# EasyEDA Pro project URADORRY-SUN1.2.eprj, schematic Main(1.2) (continued)
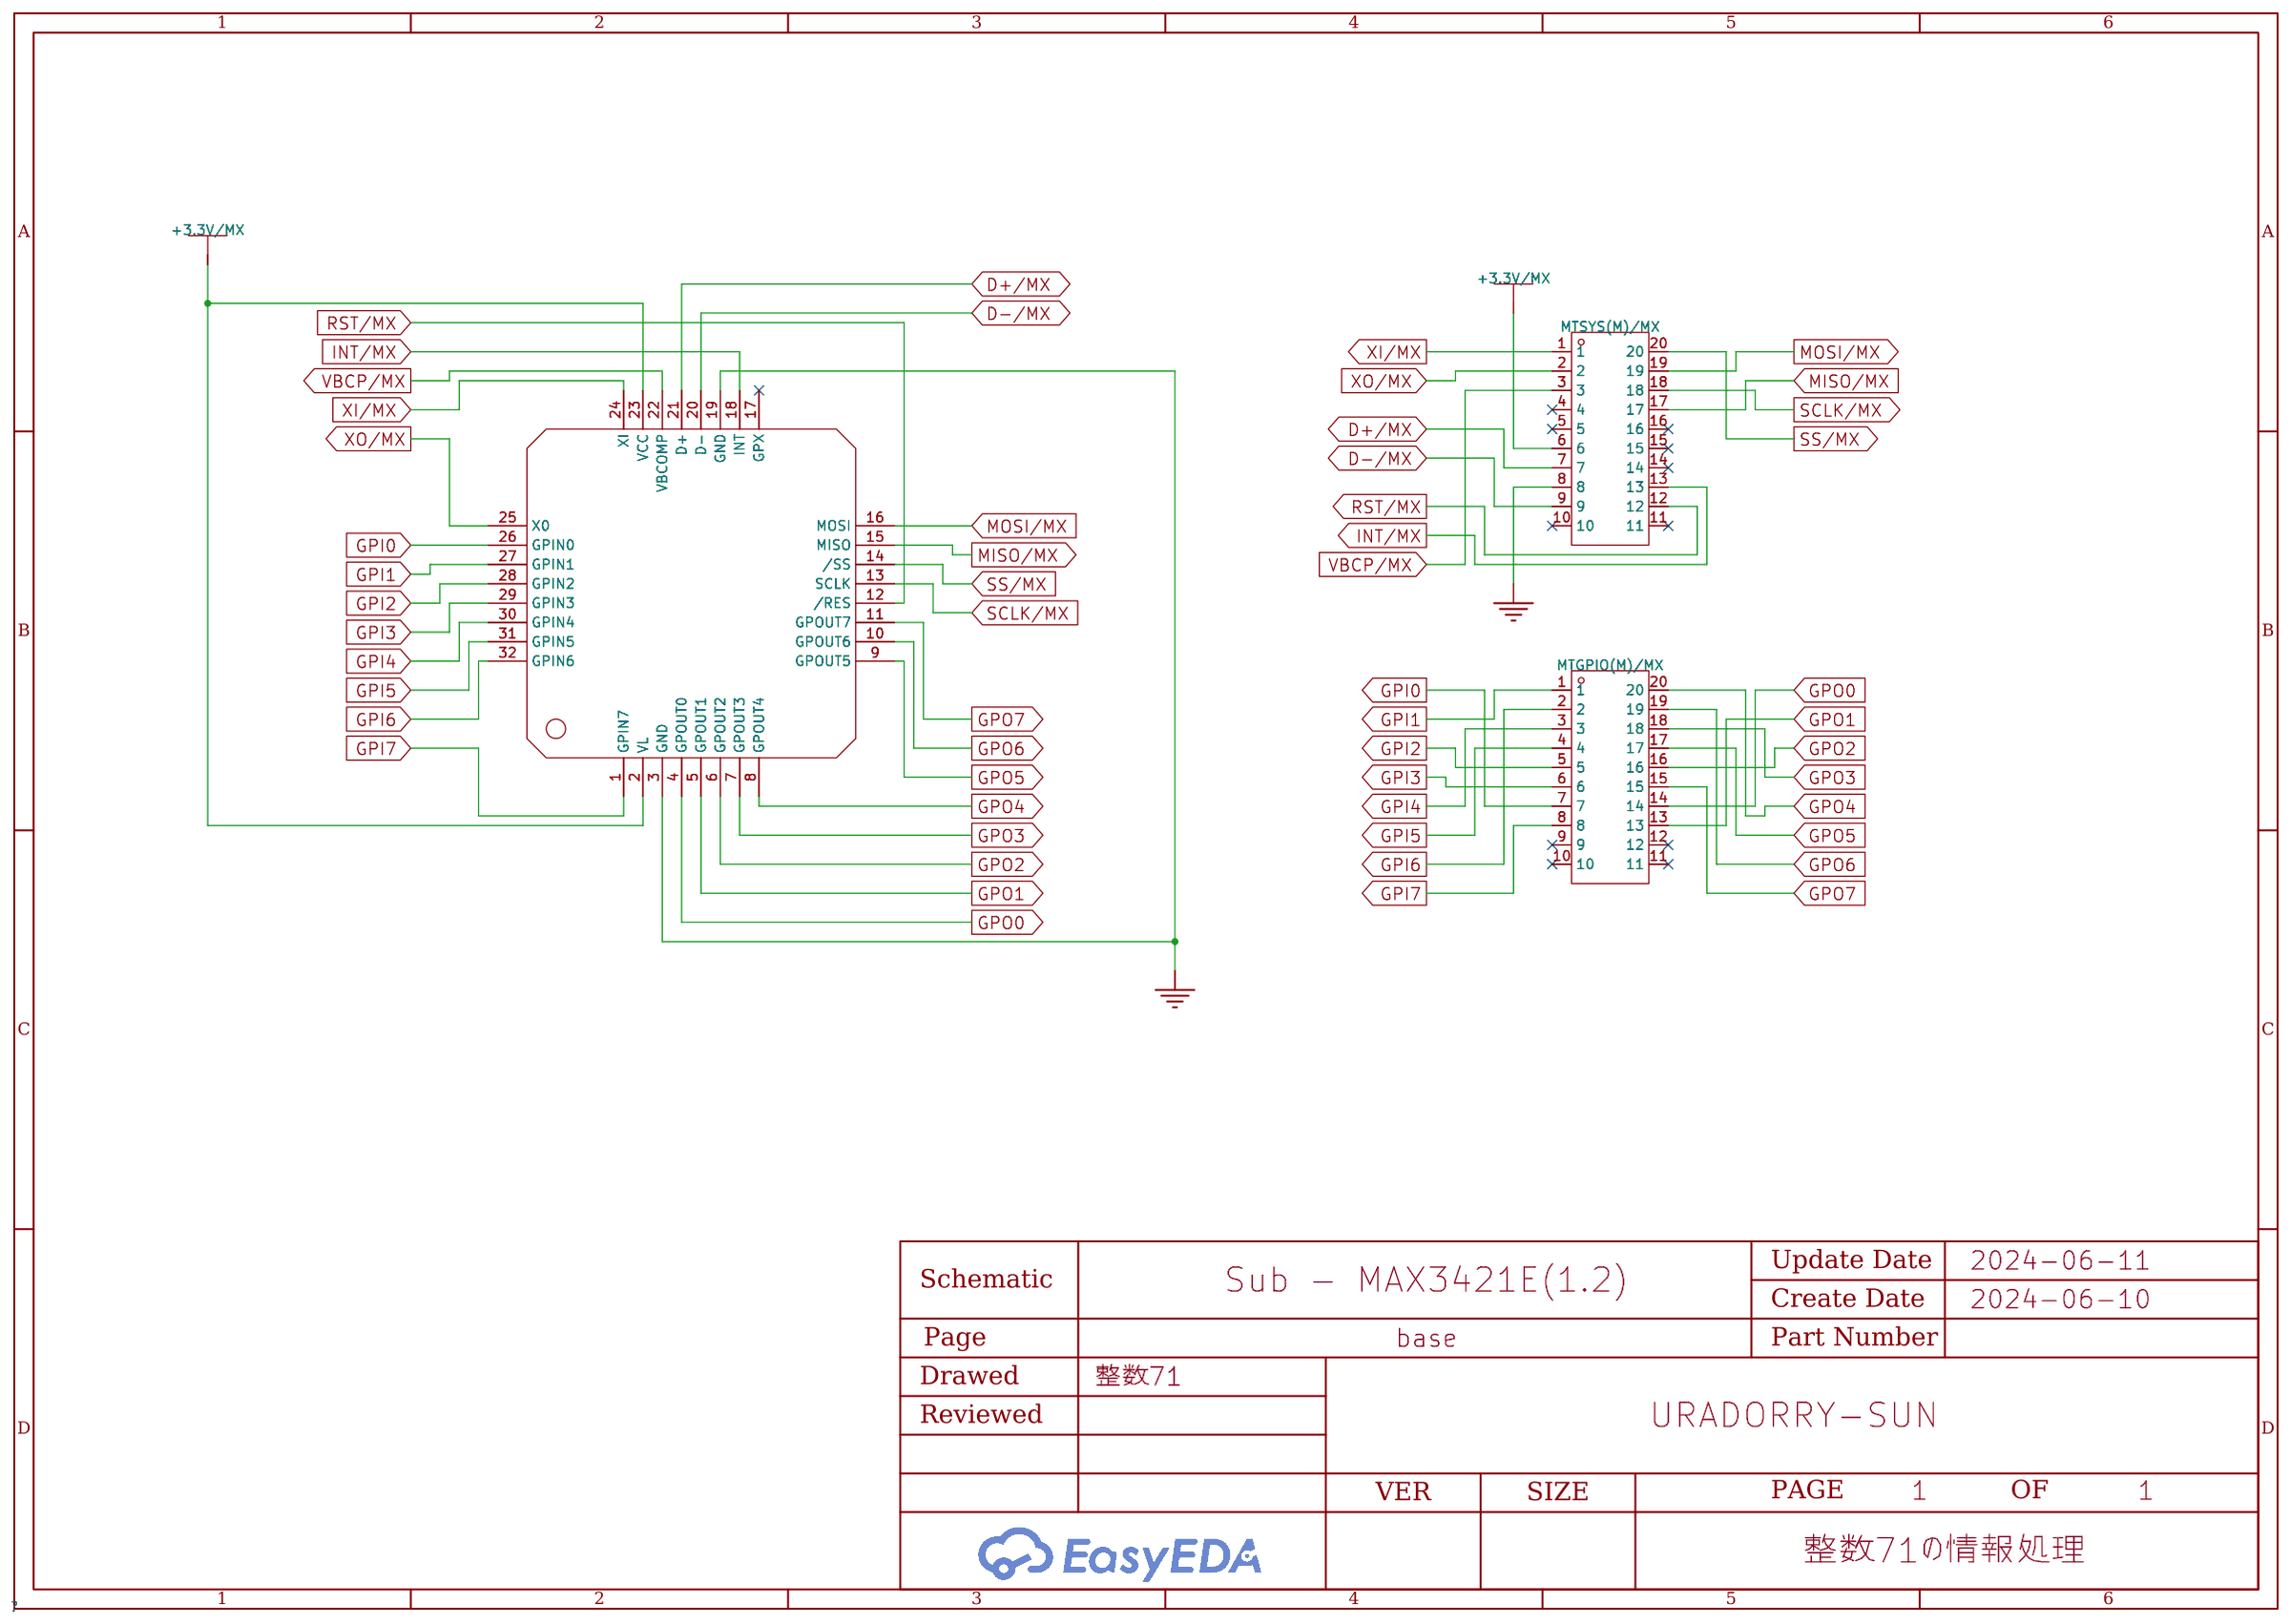
[diagram p0: schematic sheet]
## Library data of the parts (continued)
PINICSP = PinHeader-ICSP(6M) - Plugin2.54mm: Connector Type:简牛座 Pitch:2.54mm Structure:2x3P Current Rating (Max):3A Voltage Rating (Max):250V Holder Type:Straight Row Spacing:2.54mm Number of Rows:2 Pin Number in each Row:3 Operating Temperature Range:-40℃~+105℃ Operating Temperature Range:-40℃~+105; LCSC Part Name: 2.54mm 2x3P 排数:2 每排P数:3; Supplier Part: C2833845; Manufacturer: TXGA(特思嘉); Supplier Footprint: 插件,P=2.54mm; JLCPCB Part Class: Extended Part; Datasheet: https://atta.szlcsc.com/upload/public/pdf/source/20210517/C2833830_56D155BAD5515B3E78E7A5BA70C5789E.pdf; Supplier: LCSC; Connector Type: 简牛座; Pitch: 2.54mm; Structure: 2x3P; Current Rating (Max): 3A; Voltage Rating (Max): 250V; Holder Type: Straight; Row Spacing: 2.54mm; Number of Rows: 2; Pin Number in each Row: 3; Operating Temperature Range: -40℃~+105℃
RC/LM = 47kΩ(±1%) - Plugin3.5mm: Type:Metal Film Resistors Resistance: Tolerance:±1% Tolerance:±1% Overload Voltage (Max):150V Power(Watts):125mW Temperature Coefficient:±50ppm/℃ Temperature Coefficient:±50ppm/℃ Operating Temperature Range:-55℃~+125℃ Operating Temperature Range:-55℃~+125; LCSC Part Name: 47kΩ ±1% 125mW 金属膜电阻; Supplier Part: C433476; Manufacturer: Tyohm(幸亚电阻); Manufacturer Part: RN 1/8W 47K F T/B A1; Supplier Footprint: 插件,D1.7xL3.5mm; JLCPCB Part Class: Extended Part; Datasheet: https://atta.szlcsc.com/upload/public/pdf/source/20191008/C433681_B72693A7FD256E0D1DC5EFE3F095EED3.pdf; Supplier: LCSC; Type: Metal Film Resistors; Tolerance: ±1%; Overload Voltage (Max): 150V; Power(Watts): 125mW; Temperature Coefficient: ±50ppm/℃; Operating Temperature Range: -55℃~+125℃
RF1/LM = 100kΩ(±25%) - Plugin: Resistance: Tolerance:±25% Tolerance:±25% Power(Watts):; LCSC Part Name: 100kΩ ±25%; Supplier Part: C5205024; Manufacturer: BOCHEN(博晨); Manufacturer Part: RM065-104(100K); Supplier Footprint: 插件; JLCPCB Part Class: Extended Part; Datasheet: https://atta.szlcsc.com/upload/public/pdf/source/20221019/6263C46FBC7F1B66CBAADA74DC5EFAA2.pdf; Supplier: LCSC; Tolerance: ±25%
RF2/LM = 20kΩ(±1%) - Plugin3.2mm: Type:Metal Film Resistors Resistance: Tolerance:±1% Tolerance:±1% Overload Voltage (Max):150V Power(Watts):125mW Temperature Coefficient:±100ppm/℃ Temperature Coefficient:±100ppm/℃ Operating Temperature Range:-55℃~+155℃ Operating Temperature Range:-55℃~+1; LCSC Part Name: 20kΩ ±1% 125mW 金属膜电阻; Supplier Part: C119208; Manufacturer: CCO(千志电子); Manufacturer Part: MF1/8W-20KΩ±1% T; Supplier Footprint: 插件,D1.8xL3.2mm; JLCPCB Part Class: Extended Part; Datasheet: https://atta.szlcsc.com/upload/public/pdf/source/20190910/C427326_62A6D058BC0FF74963A2F22379CA06CE.pdf; Supplier: LCSC; Type: Metal Film Resistors; Tolerance: ±1%; Overload Voltage (Max): 150V; Power(Watts): 125mW; Temperature Coefficient: ±100ppm/℃; Operating Temperature Range: -55℃~+155℃
RLED+3.3V RLEDGPO0 RLEDGPO3 RLEDGPO5 RLEDRX/AT = 300Ω(±1%) - Plugin3.5mm: Type:Metal Film Resistors Resistance: Tolerance:±1% Tolerance:±1% Overload Voltage (Max):150V Power(Watts):125mW Temperature Coefficient:±50ppm/℃ Temperature Coefficient:±50ppm/℃ Operating Temperature Range:-55℃~+125℃ Operating Temperature Range:-55℃~+125; LCSC Part Name: 300Ω ±1% 125mW 金属膜电阻; Supplier Part: C433484; Manufacturer: Tyohm(幸亚电阻); Manufacturer Part: RN 1/8W 300R F T/B A1; Supplier Footprint: 插件,D1.7xL3.5mm; JLCPCB Part Class: Extended Part; Datasheet: https://atta.szlcsc.com/upload/public/pdf/source/20191008/C433681_B72693A7FD256E0D1DC5EFE3F095EED3.pdf; Supplier: LCSC; Type: Metal Film Resistors; Tolerance: ±1%; Overload Voltage (Max): 150V; Power(Watts): 125mW; Temperature Coefficient: ±50ppm/℃; Operating Temperature Range: -55℃~+125℃
SPLY+3.3V = 3.3V(～18V) - SOT89-3: Output Type:固定 Maximum Input Voltage:18V Output Voltage:3.3V Output Voltage:3.3V MAX Output Current:1A Dropout Voltage:1.4V@(1A) Output Polarity:Positive electrode Number of Outputs:1; LCSC Part Name: 输入18V 输出3.3V 1A; Supplier Part: C5345982; Manufacturer: HXY MOSFET(华轩阳电子); Supplier Footprint: SOT-89-3L; JLCPCB Part Class: Extended Part; Datasheet: https://atta.szlcsc.com/upload/public/pdf/source/20230109/63F572526B89D15A51FEAC29407041C4.pdf; Supplier: LCSC; Output Type: 固定; Maximum Input Voltage: 18V; Output Voltage: 3.3V; MAX Output Current: 1A; Dropout Voltage: 1.4V@(1A); Output Polarity: Positive electrode; Number of Outputs: 1
SPLY+7V = 7V(-0.3～6.5V→-0.3～21V) - WSON10-EP(3x3): Function:boost converterType Output Type:Adjustable Input Voltage:2.7V~5.5V Input Voltage:2.7V~5.5V Output Voltage:2.7V~18V Output Voltage:2.7V~18V Output Current (Max):1A Switching Frequency:1MHz Operating Temperature:-40℃~+85℃@(TA) Operating Temperature; Supplier: LCSC; Supplier Part: C2650328; Manufacturer: TI(德州仪器); JLCPCB Part Class: Extended Part; Supplier Footprint: WSON-10-EP(3x3); Datasheet: https://www.ti.com/cn/lit/gpn/lm4510; Function: boost converterType; Output Type: Adjustable; Input Voltage: 2.7V~5.5V; Output Voltage: 2.7V~18V; Output Current (Max): 1A; Switching Frequency: 1MHz; Operating Temperature: -40℃~+85℃@(TA); Synchronous Rectification: Yes; Number of Outputs: 1; Topology: Boost; Switch tube (built-in/external): 内置
D-SUB(9F) = DSUB(9F) - PushPull: Connector Type:D-Sub Gender:Female Number of Pins:9P Mounting Style:Right-Angle Number of Rows:2 Current Rating (Max):3A Contact Plating:Tin Operating Temperature Range:-50℃~+105℃ Operating Temperature Range:-50℃~+105℃; LCSC Part Name: D-Sub 母 P数:9P; Supplier Part: C19077337; Manufacturer: XUNPU(讯普); Supplier Footprint: 弯插; JLCPCB Part Class: Extended Part; Datasheet: https://atta.szlcsc.com/upload/public/pdf/source/20231108/FB2E8AB0BE4F620DDF3F7F4D0B9AFB97.pdf; Supplier: LCSC; Connector Type: D-Sub; Gender: Female; Number of Pins: 9P; Mounting Style: Right-Angle; Number of Rows: 2; Current Rating (Max): 3A; Contact Plating: Tin; Operating Temperature Range: -50℃~+105℃
JPCTS-AT JPCTS-RS JPRTS-AT JPRTS-RS JPRXD-AT JPRXD-RS JPTXD-AT JPTXD-RS = Jumper(2F) - Plugin2.54mm: Holes Structure:1x2P Pitch:2.54mm Row Spacing:- Circular Hole / Square Hole:Circular Holes Mounting Type:Straight Number of Rows:Plugin Number of Holes:2P Current Rating (Max):3A Voltage Rating (Max):- Holes Direction:Top Operating Temperature Range:-40℃~; Supplier: LCSC; Supplier Part: C2889984; Manufacturer: XFCN(兴飞); JLCPCB Part Class: Extended Part; LCSC Part Name: 间距:2.54mm 1x2P 直插; Supplier Footprint: 插件,P=2.54mm; Datasheet: https://atta.szlcsc.com/upload/public/pdf/source/20230817/F1E7C8AF4F247FEEDC99F0166D793EB1.pdf; Holes Structure: 1x2P; Pitch: 2.54mm; Circular Hole / Square Hole: Circular Holes; Mounting Type: Straight; Number of Rows: Plugin; Number of Holes: 2P; Current Rating (Max): 3A; Holes Direction: Top; Operating Temperature Range: -40℃~+105℃
UARTtoRS232C = UARTtoRS232C - TSSOP16: Types:transceiver Driver/receiver:2/2 Data Rate:460Kbps Data Rate:460Kbps Supply Voltage:3V~5.5V Supply Voltage:3V~5.5V Operating Temperature:-40℃~+85℃ Operating Temperature:-40℃~+85℃; Supplier Part: C125860; Manufacturer: ADI(亚德诺); Supplier Footprint: TSSOP-16; JLCPCB Part Class: Extended Part; Datasheet: https://atta.szlcsc.com/upload/public/pdf/source/20140724/1457707160156.pdf; Supplier: LCSC; Types: transceiver; Driver/receiver: 2/2; Data Rate: 460Kbps; Supply Voltage: 3V~5.5V; Operating Temperature: -40℃~+85℃
CXI/MX CXO/MX CXTAL1/AT CXTAL2/AT = 20pF(±5%) - Plugin5.08mm: Capacitance: Tolerance:±5% Tolerance:±5% Voltage Rated: Temperature Coefficient:NP0; Supplier: LCSC; Supplier Part: C2761744; Manufacturer: Dersonic(德尔创); Manufacturer Part: CD1H200JC9BECHD100; JLCPCB Part Class: Extended Part; LCSC Part Name: 20pF ±5% 50V; Supplier Footprint: 插件,P=5.08mm; Datasheet: https://atta.szlcsc.com/upload/public/pdf/source/20210512/C2761744_B1A0D4C027D843B54401A3CD3D312F15.pdf; Tolerance: ±5%; Temperature Coefficient: NP0
LEDGPO3 LEDRX/AT = GreenYellow(2.0V,5mA) - 0603: Emitted Color:Green-yellow Forward Voltage (VF):1.6V~2.6V Forward Voltage (VF):1.6V~2.6V Power Dissipation:65mW Forward Current:5mA Dominant Wavelength:565nm~578nm Dominant Wavelength:565nm~578nm Lens Color:无色透明透镜 Luminous Intensity:5mcd~13mcd Luminous In; Supplier: LCSC; Manufacturer: 国星光电; Supplier Part: C84264; JLCPCB Part Class: Extended Part; Supplier Footprint: 0603; Datasheet: https://atta.szlcsc.com/upload/public/pdf/source/20200820/C84264_94B2FEF0C4ADFC9200EBC3AD62A401B4.pdf; Emitted Color: Green-yellow; Forward Voltage (VF): 1.6V~2.6V; Power Dissipation: 65mW; Forward Current: 5mA; Dominant Wavelength: 565nm~578nm; Lens Color: 无色透明透镜; Luminous Intensity: 5mcd~13mcd; Viewing Angle: 140°; Operating Temperature: -30℃~+85℃
LEDGPO2 LEDTX/AT = Emerald(2.7～3.1V,5mA) - 0603: Lamp Holder Type:- Emitted Color:Emerald Forward Voltage (VF):2.6V~3V Forward Voltage (VF):2.6V~3V Power Dissipation:75mW Forward Current:5mA Dominant Wavelength:505nm~540nm Dominant Wavelength:505nm~540nm Peak Wavelength:530nm Diode Configuration:- Lens; Supplier Part: C7371905; Manufacturer: XINGLIGHT(成兴光); Supplier Footprint: 0603; JLCPCB Part Class: Extended Part; Datasheet: https://atta.szlcsc.com/upload/public/pdf/source/20240218/2F8A7AF596DEEB38157DAB7856E382C0.pdf; Supplier: LCSC; Emitted Color: Emerald; Forward Voltage (VF): 2.6V~3V; Power Dissipation: 75mW; Forward Current: 5mA; Dominant Wavelength: 505nm~540nm; Peak Wavelength: 530nm; Lens Color: 绿色透镜; Luminous Intensity: 299mcd; Viewing Angle: 130°; Mounting Sytle: 正贴
Micro-B = USB2.0-Micro-B(F) - SMD: Connector Type:Micro-B Gender:Female Number of Ports:1 Number of Contacts:5P Mounting Style:卧贴 Current Rating - Power (Max):1A Operating Temperature Range:-30℃~+80℃ Operating Temperature Range:-30℃~+80℃; Supplier: LCSC; Supplier Part: C5160306; Manufacturer: hanxia(韩下); JLCPCB Part Class: Extended Part; LCSC Part Name: Micro-B 母 卧贴; Supplier Footprint: SMD; Datasheet: https://atta.szlcsc.com/upload/public/pdf/source/20220913/7E2C2455EEF20DEDB240D9492EBB4E23.pdf; Gender: Female; Number of Ports: 1; Number of Contacts: 5P; Mounting Style: 卧贴; Current Rating - Power (Max): 1A; Operating Temperature Range: -30℃~+80℃
MTAPP(F)/AT MTGPIO(F)/MX MTSYS(F)/AT MTSYS(F)/MX = Mezzanine(20F) - SMD0.5mm: Number of Pins:- Pitch:0.5mm Gender:Female Mounting Style:Brick nogging Number of Rows:2 Contact Plating:Gold; LCSC Part Name: 间距:0.5mm 母 立贴; Supplier Part: C2917018; Manufacturer: PANASONIC(松下); Supplier Footprint: SMD,P=0.5mm; JLCPCB Part Class: Extended Part; Datasheet: https://atta.szlcsc.com/upload/public/pdf/source/20220311/6F5DC41F043C9CF6954EB51995931AE2.pdf; Supplier: LCSC; Pitch: 0.5mm; Gender: Female; Mounting Style: Brick nogging; Number of Rows: 2; Contact Plating: Gold
RCC1/UD1 RCC2/UD1 = 5.1kΩ(±1%) - 0402: Type:Thick Film Resistors Resistance:5.1kΩ Tolerance:±1% Tolerance:±1% Power(Watts): Overload Voltage (Max): Temperature Coefficient:±100ppm/℃ Temperature Coefficient:±100ppm/℃ Operating Temperature Range:-55℃~+155℃ Operating Temperature Range:-55℃~+155℃; Supplier: LCSC; Manufacturer: UNI-ROYAL(厚声); Manufacturer Part: 0402WGF5101TCE; Supplier Part: C25905; JLCPCB Part Class: Basic Part; LCSC Part Name: 5.1kΩ ±1% 62.5mW 厚膜电阻; Supplier Footprint: 0402; Datasheet: https://atta.szlcsc.com/upload/public/pdf/source/20200306/C422600_1E6D84923E4A46A82E41ADD87F860B5C.pdf; Type: Thick Film Resistors; Tolerance: ±1%; Temperature Coefficient: ±100ppm/℃; Operating Temperature Range: -55℃~+155℃
RD+/UD RD-/UD = 22Ω(±1%) - 0402: Type:Thick Film Resistors Resistance:22Ω Tolerance:±1% Tolerance:±1% Power(Watts): Overload Voltage (Max): Temperature Coefficient:±100ppm/℃ Temperature Coefficient:±100ppm/℃ Operating Temperature Range:-55℃~+155℃ Operating Temperature Range:-55℃~+155℃; Supplier: LCSC; Manufacturer: UNI-ROYAL(厚声); Manufacturer Part: 0402WGF220JTCE; Supplier Part: C25092; JLCPCB Part Class: Basic Part; LCSC Part Name: 22Ω ±1% 62.5mW 厚膜电阻; Supplier Footprint: 0402; Datasheet: https://atta.szlcsc.com/upload/public/pdf/source/20200306/C422600_1E6D84923E4A46A82E41ADD87F860B5C.pdf; Type: Thick Film Resistors; Tolerance: ±1%; Temperature Coefficient: ±100ppm/℃; Operating Temperature Range: -55℃~+155℃
RLEDGPO1 RLEDGPO2 RLEDGPO4 RLEDGPO6 RLEDGPO7 RLEDTX/AT = 100Ω(±1%) - Plugin3.5mm: Type:Metal Film Resistors Resistance: Tolerance:±1% Tolerance:±1% Overload Voltage (Max):250V Temperature Coefficient:±100ppm/℃ Temperature Coefficient:±100ppm/℃; LCSC Part Name: 金属膜电阻 100Ω ±1%; Supplier Part: C274527; Manufacturer: 双羽; Manufacturer Part: RNS14F1000A520NH; Supplier Footprint: 插件,D1.7xL3.5mm; JLCPCB Part Class: Extended Part; Datasheet: https://atta.szlcsc.com/upload/public/pdf/source/20181008/C275112_61B57CF4FECD9E771366D1DDFC695024.pdf; Supplier: LCSC; Type: Metal Film Resistors; Tolerance: ±1%; Overload Voltage (Max): 250V; Temperature Coefficient: ±100ppm/℃
RRST = 10kΩ(±1%) - 0402: Type:Thick Film Resistors Resistance:10kΩ Tolerance:±1% Tolerance:±1% Power(Watts): Overload Voltage (Max): Temperature Coefficient:±100ppm/℃ Temperature Coefficient:±100ppm/℃ Operating Temperature Range:-55℃~+155℃ Operating Temperature Range:-55℃~+155℃; LCSC Part Name: 10kΩ ±1% 62.5mW 厚膜电阻; Supplier Part: C25744; Manufacturer: UNI-ROYAL(厚声); Manufacturer Part: 0402WGF1002TCE; Supplier Footprint: 0402; JLCPCB Part Class: Basic Part; Datasheet: https://atta.szlcsc.com/upload/public/pdf/source/20200306/C422600_1E6D84923E4A46A82E41ADD87F860B5C.pdf; Supplier: LCSC; Type: Thick Film Resistors; Tolerance: ±1%; Temperature Coefficient: ±100ppm/℃; Operating Temperature Range: -55℃~+155℃
Type-C = USB3.1-Type-C(F) - SMD: Connector Type:Type-C Standard:- Gender:Female Number of Ports:1 Number of Contacts:16P Mounting Style:卧贴 Current Rating - Power (Max):3A Operating Temperature Range:-40℃~+85℃ Operating Temperature Range:-40℃~+85℃; Supplier: LCSC; Supplier Part: C393939; Manufacturer: SHOU HAN(首韩); JLCPCB Part Class: Extended Part; LCSC Part Name: Type-C 母 卧贴; Supplier Footprint: SMD; Datasheet: https://atta.szlcsc.com/upload/public/pdf/source/20190521/C393939_7B9043D4CF1026AF443AB60D91FBCD5C.pdf; Gender: Female; Number of Ports: 1; Number of Contacts: 16P; Mounting Style: 卧贴; Current Rating - Power (Max): 3A; Operating Temperature Range: -40℃~+85℃
XTAL/AT = 16MHz(20pF,±10ppm) - HC49S: Crystal Type:直插晶振 Frequency: Normal temperature Frequency Tolerance:±10ppm Normal temperature Frequency Tolerance:±10ppm External load capacitor: Frequency Stability(Full temperature range):±10ppm Frequency Stability(Full temperature range):±10ppm Equival; Supplier: LCSC; Supplier Part: C718645; Manufacturer: LIMING(利明); Manufacturer Part: 49SS-16.00-20-10-10/B; JLCPCB Part Class: Extended Part; LCSC Part Name: 16MHz ±10ppm 20pF; Supplier Footprint: HC-49S; Crystal Type: 直插晶振; Normal temperature Frequency Tolerance: ±10ppm; Frequency Stability(Full temperature range): ±10ppm
LEDGPO0 = Amber(1.7～2.2V,5mA) - 0603: Emitted Color:Amber Color Power Dissipation:60mW Forward Current:5mA Dominant Wavelength:605nm Dominant Wavelength:605nm Peak Wavelength:611nm Diode Configuration:- Lens Color:无色透明透镜 Color Temperature:- Color Temperature:- Viewing Angle:120° Mounting Sytl; LCSC Part Name: 琥珀; Supplier Part: C264473; Manufacturer: EVERLIGHT(亿光); Supplier Footprint: 0603; JLCPCB Part Class: Extended Part; Datasheet: https://atta.szlcsc.com/upload/public/pdf/source/20200413/C264473_486C5A358991DBAE924B1A7DFA97F650.pdf; Supplier: LCSC; Emitted Color: Amber Color; Power Dissipation: 60mW; Forward Current: 5mA; Dominant Wavelength: 605nm; Peak Wavelength: 611nm; Lens Color: 无色透明透镜; Viewing Angle: 120°; Operating Temperature: -40℃~+85℃
LEDGPO1 = Blue(2.7～3.1V,5mA) - 0603: Lamp Holder Type:- Emitted Color:Blue Forward Voltage (VF):2.6V~3V Forward Voltage (VF):2.6V~3V Power Dissipation:75mW Forward Current:5mA Dominant Wavelength:456nm~476nm Dominant Wavelength:456nm~476nm Peak Wavelength:- Diode Configuration:- Lens Color:无; Supplier Part: C7371904; Manufacturer: XINGLIGHT(成兴光); Supplier Footprint: 0603; JLCPCB Part Class: Extended Part; Datasheet: https://atta.szlcsc.com/upload/public/pdf/source/20230616/D80F8398A763D2D3FF676DEF9776FF90.pdf; Supplier: LCSC; Emitted Color: Blue; Forward Voltage (VF): 2.6V~3V; Power Dissipation: 75mW; Forward Current: 5mA; Dominant Wavelength: 456nm~476nm; Lens Color: 无色透明透镜; Luminous Intensity: 130mcd; Viewing Angle: 130°; Mounting Sytle: 正贴
LEDGPO4 = Pink(2.7～3.3V,5mA) - 0603: Lamp Holder Type:- Emitted Color:Pink Forward Voltage (VF):- Forward Voltage (VF):- Power Dissipation:80mW Forward Current:5mA Dominant Wavelength:- Dominant Wavelength:- Peak Wavelength:- Diode Configuration:- Lens Color:粉色透镜 Color Temperature:- Color Te; Supplier Part: C2977076; Manufacturer: XINGLIGHT(成兴光); Supplier Footprint: 0603; JLCPCB Part Class: Extended Part; Datasheet: https://atta.szlcsc.com/upload/public/pdf/source/20221102/10CD74551B91639B3CF9699D266872B7.pdf; Supplier: LCSC; Emitted Color: Pink; Power Dissipation: 80mW; Forward Current: 5mA; Lens Color: 粉色透镜; Viewing Angle: 120°; Mounting Sytle: Positive post; Operating Temperature: -30℃~+85℃
LEDGPO5 = Purple(1.9～2.1V,5mA) - 0603: Lamp Holder Type:- Emitted Color:Purple Forward Voltage (VF):2.9V~3.5V Forward Voltage (VF):2.9V~3.5V Power Dissipation:75mW Forward Current:5mA Dominant Wavelength:390nm~447nm Dominant Wavelength:390nm~447nm Peak Wavelength:- Diode Configuration:- Lens C; Supplier: LCSC; Supplier Part: C7371898; Manufacturer: XINGLIGHT(成兴光); JLCPCB Part Class: Extended Part; Supplier Footprint: 0603; Datasheet: https://atta.szlcsc.com/upload/public/pdf/source/20230616/FEA7015A1534BD419E555778D11400E2.pdf; Emitted Color: Purple; Forward Voltage (VF): 2.9V~3.5V; Power Dissipation: 75mW; Forward Current: 5mA; Dominant Wavelength: 390nm~447nm; Lens Color: 无色透明透镜; Luminous Intensity: 25mcd; Viewing Angle: 120°; Mounting Sytle: 正贴
LEDGPO6 = SkyBlue(2.8V,5mA) - 0603: Emitted Color:天蓝色 Forward Voltage (VF):2.6V~3.6V Forward Voltage (VF):2.6V~3.6V Power Dissipation:72mW Forward Current:5mA Lens Color:雾状黄透镜 Luminous Intensity:440mcd~700mcd Luminous Intensity:440mcd~700mcd Viewing Angle:130° Operating Temperature:-30℃~+85; Supplier: LCSC; Manufacturer: 国星光电; Supplier Part: C85323; JLCPCB Part Class: Extended Part; Supplier Footprint: 0603; Datasheet: https://atta.szlcsc.com/upload/public/pdf/source/20200820/C85323_EEBDE1991D282852A802CC924755041E.pdf; Emitted Color: 天蓝色; Forward Voltage (VF): 2.6V~3.6V; Power Dissipation: 72mW; Forward Current: 5mA; Lens Color: 雾状黄透镜; Luminous Intensity: 440mcd~700mcd; Viewing Angle: 130°; Operating Temperature: -30℃~+85℃
LEDGPO7 = White(2.8V,5mA) - 0603: Emitted Color:White Forward Voltage (VF):2.6V~3.6V Forward Voltage (VF):2.6V~3.6V Power Dissipation:72mW Forward Current:5mA Lens Color:雾状黄透镜 Luminous Intensity:200mcd~300mcd Luminous Intensity:200mcd~300mcd Viewing Angle:130° Operating Temperature:-30℃~+; Supplier Part: C84265; Manufacturer: 国星光电; Supplier Footprint: 0603; JLCPCB Part Class: Extended Part; Datasheet: https://atta.szlcsc.com/upload/public/pdf/source/20200820/C84265_479E6193713348A548E5CD6D9278BF16.pdf; Supplier: LCSC; Emitted Color: White; Forward Voltage (VF): 2.6V~3.6V; Power Dissipation: 72mW; Forward Current: 5mA; Lens Color: 雾状黄透镜; Luminous Intensity: 200mcd~300mcd; Viewing Angle: 130°; Operating Temperature: -30℃~+85℃
RD+/UH RD-/UH = 33Ω(±1%) - 0402: Type:Thick Film Resistors Resistance:33Ω Tolerance:±1% Tolerance:±1% Power(Watts): Overload Voltage (Max): Temperature Coefficient:±100ppm/℃ Temperature Coefficient:±100ppm/℃ Operating Temperature Range:-55℃~+155℃ Operating Temperature Range:-55℃~+155℃; Supplier: LCSC; Manufacturer: UNI-ROYAL(厚声); Manufacturer Part: 0402WGF330JTCE; Supplier Part: C25105; JLCPCB Part Class: Basic Part; LCSC Part Name: 33Ω ±1% 62.5mW 厚膜电阻; Supplier Footprint: 0402; Datasheet: https://atta.szlcsc.com/upload/public/pdf/source/20200306/C422600_1E6D84923E4A46A82E41ADD87F860B5C.pdf; Type: Thick Film Resistors; Tolerance: ±1%; Temperature Coefficient: ±100ppm/℃; Operating Temperature Range: -55℃~+155℃
RINT/MX = 2.2kΩ(±1%) - 0402: Type:Thick Film Resistors Resistance:2.2kΩ Tolerance:±1% Tolerance:±1% Power(Watts): Overload Voltage (Max): Temperature Coefficient:±100ppm/℃ Temperature Coefficient:±100ppm/℃ Operating Temperature Range:-55℃~+155℃ Operating Temperature Range:-55℃~+155℃; Supplier: LCSC; Manufacturer: UNI-ROYAL(厚声); Manufacturer Part: 0402WGF2201TCE; Supplier Part: C25879; JLCPCB Part Class: Basic Part; LCSC Part Name: 2.2kΩ ±1% 62.5mW 厚膜电阻; Supplier Footprint: 0402; Datasheet: https://atta.szlcsc.com/upload/public/pdf/source/20200306/C422600_1E6D84923E4A46A82E41ADD87F860B5C.pdf; Type: Thick Film Resistors; Tolerance: ±1%; Temperature Coefficient: ±100ppm/℃; Operating Temperature Range: -55℃~+155℃
SW-GPI/MX = DIP(8) - SMD16P: Type:平拨,凹槽式 Circuit:SPST Number of Positions:8Bit Lead Pitch:1.27mm Operating Life:- Color:Black; LCSC Part Name: 8位 包含引脚总宽度6.7mm 贴片; Supplier Part: C224998; Manufacturer: Diptronics(圜达); Supplier Footprint: SMD-16P,4.5x11.4mm; JLCPCB Part Class: Extended Part; Datasheet: https://atta.szlcsc.com/upload/public/pdf/source/20180517/C224998_EA354538787C758683996AD90494F89B.pdf; Supplier: LCSC; Type: 平拨,凹槽式; Circuit: SPST; Number of Positions: 8Bit; Lead Pitch: 1.27mm; Color: Black
Type-A = USB2.0-Type-A(F) - Plugin: Connector Type:Type-A Standard:USB 2.0 Gender:Female Number of Ports:1 Number of Contacts:4P Mounting Style:Right-Angle Current Rating - Power (Max):1.5A Operating Temperature Range:-25℃~+85℃ Operating Temperature Range:-25℃~+85℃; LCSC Part Name: Type-A 母 弯插; Supplier Part: C6386909; Manufacturer: SHOU HAN(首韩); Supplier Footprint: 插件; JLCPCB Part Class: Extended Part; Datasheet: https://atta.szlcsc.com/upload/public/pdf/source/20240129/489A03AE73FEB82181FE96F64E58A2E6.pdf; Supplier: LCSC; Standard: USB 2.0; Gender: Female; Number of Ports: 1; Number of Contacts: 4P; Mounting Style: Right-Angle; Current Rating - Power (Max): 1.5A; Operating Temperature Range: -25℃~+85℃
XTAL/MX = 12MHz(20pF,±10ppm) - HC49S: Crystal Type:直插晶振 Frequency: Normal temperature Frequency Tolerance:±10ppm Normal temperature Frequency Tolerance:±10ppm External load capacitor: Frequency Stability(Full temperature range):±30ppm Frequency Stability(Full temperature range):±30ppm Operati; LCSC Part Name: 12MHz ±10ppm 20pF; Supplier Part: C188203; Manufacturer: YXC(扬兴晶振); Manufacturer Part: X49SD12MSB2SI; Supplier Footprint: HC-49S; JLCPCB Part Class: Extended Part; Datasheet: https://atta.szlcsc.com/upload/public/pdf/source/20240329/977D7F2434F98B2BE33270BB9FF3D86D.pdf; Supplier: LCSC; Crystal Type: 直插晶振; Normal temperature Frequency Tolerance: ±10ppm; Frequency Stability(Full temperature range): ±30ppm
JP+3.3V JP+5V JPD+ JPD- JPMISO JPMOSI JPRAW2 JPRST JPSCLK JPSS = Jumper(3M) - Plugin2.54mm: Pin Structure:1x3P Pitch:2.54mm Row Spacing:- Circluar Pins/Square Pins:Square Pins Mounting Type:Straight Number of Rows:Plugin Number of Pins:3P Current Rating (Max):3A Voltage Rating (Max):250V Length of Mating Pin:6mm Insulation Height:2.5mm Length of; LCSC Part Name: 间距:2.54mm 1x3P 直插 方针; Supplier Part: C2937625; Manufacturer: XFCN(兴飞); Supplier Footprint: 插件,P=2.54mm; JLCPCB Part Class: Extended Part; Datasheet: https://atta.szlcsc.com/upload/public/pdf/source/20200309/C492402_8335C3D49C4E4C618838D59BB1D024C1.pdf; Supplier: LCSC; Pin Structure: 1x3P; Pitch: 2.54mm; Circluar Pins/Square Pins: Square Pins; Mounting Type: Straight; Number of Rows: Plugin; Number of Pins: 3P; Current Rating (Max): 3A; Voltage Rating (Max): 250V; Length of Mating Pin: 6mm; Insulation Height: 2.5mm; Length of End Connection Pin: 3mm; Operating Temperature Range: -40℃~+105℃; Color: Black
SWRST = Tactile - SMD: Circuit:SPST Actuator Style:Round Button Operating Force:180gf Mounting Style:Brick nogging Switch Length:4mm Switch Width:3mm Switch Height:2mm Strike Gundam:不带 Contact Current:50mA Voltage Rating (DC):12V Insulation Resistance:100MΩ Actuator/Cap Color:B; Supplier: LCSC; Supplier Part: C967783; Manufacturer: DGBZ(东莞博众); JLCPCB Part Class: Extended Part; LCSC Part Name: 4*3*2mm 立贴 轻触开关; Supplier Footprint: SMD; Datasheet: https://atta.szlcsc.com/upload/public/pdf/source/20220906/56D88CFA86203D2A9CD9F32104D3D590.pdf; Circuit: SPST; Actuator Style: Round Button; Operating Force: 180gf; Mounting Style: Brick nogging; Switch Length: 4mm; Switch Width: 3mm; Switch Height: 2mm; Strike Gundam: 不带; Contact Current: 50mA; Voltage Rating (DC): 12V; Insulation Resistance: 100MΩ; Actuator/Cap Color: Black; Pin Style: SMDSplicing; Mechanical Life: 5万次

## Nets
+3.3V: C3/AD.1 C5/AD.1 C+3.3V1.1 C+3.3V2.1 C+3.3V3.1 JP+3.3V.2 MTSYS(F)/AT.2 PIN+3.3V.1 RLED+3.3V.1 RLEDRX/AT.1 RLEDTX/AT.1 RRST.1 SPLY+3.3V.2(Vout) UARTtoRS232C.16(VCC)
+5V: FUSE+5V.1 JP+5V.2 JPRAW.1 MTAPP(F)/AT.4 PIN+5V.1
+7V: COUT/LM.1 PIN+7V.1 RF1/LM.2 SPLY+7V.10(VOUT)
GND: C4/AD.1 C5/AD.2 C+3.3V1.2 C+3.3V2.2 C+3.3V3.2 CAREF/AT.1 CC1/LM.2 CC2/LM.2 CIN/LM.2 COUT/LM.2 CRAW.2 CS/LM.1 CUCAP/AT.1 CVBCP/MX.1 CXI/MX.1 CXO/MX.1 CXTAL1/AT.1 CXTAL2/AT.1 D-SUB(9F).5 LED+3.3V.2(K) LEDGPO0.1(-) LEDGPO1.2(K) LEDGPO2.1(K) LEDGPO3.1(-) LEDGPO4.1(C) LEDGPO5.1(K) LEDGPO6.1(K) LEDGPO7.1(-) Micro-B.5(GND) MTSYS(F)/AT.3 MTSYS(F)/MX.4 PINGND.1 PINICSP.6 RCC1/UD1.1 RCC2/UD1.1 RF2/LM.2 SPLY+3.3V.1(ADJ/VSS) SPLY+7V.2(PGND) SPLY+7V.6(AGND) SPLY+7V.11(DAP) SW-GPI/MX.1 SW-GPI/MX.2 SW-GPI/MX.3 SW-GPI/MX.4 SW-GPI/MX.5 SW-GPI/MX.6 SW-GPI/MX.7 SW-GPI/MX.8 SWRST.1 Type-A.4(GND) Type-C.A1B12(GND) Type-C.B1A12(GND) UARTtoRS232C.15(GND)
+3.3V/MX: JP+3.3V.3 MTSYS(F)/MX.3 RINT/MX.1
+5V/U: JP+5V.3 Micro-B.1(VCC) Type-A.1(VCC) Type-C.A4B9(VBUS) Type-C.B4A9(VBUS)
AREF/AT: CAREF/AT.2 MTSYS(F)/AT.15
CTS-AT/AD: JPCTS-AT.2 UARTtoRS232C.9(R2OUT)
CTS-RS/AD: JPCTS-RS.1 UARTtoRS232C.8(R2IN)
CTS/AT: JPCTS-AT.1 LEDTX/AT.1(K) MTSYS(F)/AT.10
CTS/RS: D-SUB(9F).8 JPCTS-RS.2
D+/AT: JPD+.2 MTAPP(F)/AT.1
D+/MX: MTSYS(F)/MX.17 RD+/UH.1
D+/UD: JPD+.3 RD+/UD.1
D-/AT: JPD-.2 MTAPP(F)/AT.2
D-/MX: MTSYS(F)/MX.16 RD-/UH.1
D-/UD: JPD-.3 RD-/UD.1
GPI0: MTGPIO(F)/MX.17 SW-GPI/MX.16
GPI1: MTGPIO(F)/MX.20 SW-GPI/MX.15
GPI2: MTGPIO(F)/MX.18 SW-GPI/MX.14
GPI3: MTGPIO(F)/MX.3 SW-GPI/MX.13
GPI4: MTGPIO(F)/MX.19 SW-GPI/MX.12
GPI5: MTGPIO(F)/MX.2 SW-GPI/MX.11
GPI6: MTGPIO(F)/MX.1 SW-GPI/MX.10
GPI7: MTGPIO(F)/MX.4 SW-GPI/MX.9
GPO0: MTGPIO(F)/MX.7 RLEDGPO0.1
GPO1: MTGPIO(F)/MX.14 RLEDGPO1.1
GPO2: MTGPIO(F)/MX.8 RLEDGPO2.1
GPO3: MTGPIO(F)/MX.9 RLEDGPO3.1
GPO4: MTGPIO(F)/MX.10 RLEDGPO4.1
GPO5: MTGPIO(F)/MX.12 RLEDGPO5.1
GPO6: MTGPIO(F)/MX.11 RLEDGPO6.1
GPO7: MTGPIO(F)/MX.13 RLEDGPO7.1
INT/MX: MTSYS(F)/MX.14 RINT/MX.2
MISO/AT: JPMISO.2 MTSYS(F)/AT.20
MISO/IC: JPMISO.1 PINICSP.1
MISO/MX: JPMISO.3 MTSYS(F)/MX.12
MOSI/AT: JPMOSI.2 MTSYS(F)/AT.19
MOSI/IC: JPMOSI.1 PINICSP.4
MOSI/MX: JPMOSI.3 MTSYS(F)/MX.11
PB4: MTAPP(F)/AT.6 PINPB4.1
PB5: MTAPP(F)/AT.7 PINPB5.1
PB6: MTAPP(F)/AT.8 PINPB6.1
PC6: MTAPP(F)/AT.9 PINPC6.1
PC7: MTAPP(F)/AT.10 PINPC7.1
PD0: MTSYS(F)/AT.7 PINPD0.1
PD1: MTSYS(F)/AT.8 PINPD1.1
PD4: MTSYS(F)/AT.12 PINPD4.1
PD6: MTSYS(F)/AT.13 PINPD6.1
PD7: MTSYS(F)/AT.14 PINPD7.1
PE6: MTAPP(F)/AT.20 PINPE6.1
PF0: MTAPP(F)/AT.18 PINPF0.1
PF1: MTAPP(F)/AT.17 PINPF1.1
PF4: MTAPP(F)/AT.14 PINPF4.1
PF5: MTAPP(F)/AT.13 PINPF5.1
PF6: MTAPP(F)/AT.12 PINPF6.1
PF7: MTAPP(F)/AT.11 PINPF7.1
RAW: CIN/LM.1 CRAW.1 DVBUS.1(C) JPRAW.2 JPRAW2.2 L/LM.1 PINRAW.1 SPLY+3.3V.3(Vin) SPLY+7V.3(VIN) SPLY+7V.4(EN)
RAW/IC: JPRAW2.1 PINICSP.2
RST: JPRST.2 MTSYS(F)/AT.1 RRST.2 SWRST.2
RST/IC: JPRST.1 PINICSP.5
RST/MX: JPRST.3 MTSYS(F)/MX.6
RTS-AT/AD: JPRTS-AT.2 UARTtoRS232C.10(T2IN)
RTS-RS/AD: JPRTS-RS.1 UARTtoRS232C.7(T2OUT)
RTS/AT: JPRTS-AT.1 MTSYS(F)/AT.16
RTS/RS: D-SUB(9F).7 JPRTS-RS.2
RXD-AT/AD: JPRXD-AT.2 UARTtoRS232C.12(R1OUT)
RXD-RS/AD: JPRXD-RS.1 UARTtoRS232C.13(R1IN)
RXD/AT: JPRXD-AT.1 MTSYS(F)/AT.11
RXD/RS: D-SUB(9F).2 JPRXD-RS.2
SCLK/AT: JPSCLK.2 MTSYS(F)/AT.18
SCLK/IC: JPSCLK.1 PINICSP.3
SCLK/MX: JPSCLK.3 MTSYS(F)/MX.9
SS/AT: JPSS.2 LEDRX/AT.1(-) MTSYS(F)/AT.17
SS/MX: JPSS.3 MTSYS(F)/MX.10
TXD-AT/AD: JPTXD-AT.2 UARTtoRS232C.11(T1IN)
TXD-RS/AD: JPTXD-RS.1 UARTtoRS232C.14(T1OUT)
TXD/AT: JPTXD-AT.1 MTSYS(F)/AT.9
TXD/RS: D-SUB(9F).3 JPTXD-RS.2
UCAP/AT: CUCAP/AT.2 MTAPP(F)/AT.3
VBCP/MX: CVBCP/MX.2 MTSYS(F)/MX.19
XI/MX: CXI/MX.2 MTSYS(F)/MX.20 XTAL/MX.1(OSC1)
XO/MX: CXO/MX.2 MTSYS(F)/MX.1 XTAL/MX.2(OSC2)
XTAL1/AT: CXTAL1/AT.2 MTSYS(F)/AT.5 XTAL/AT.1
XTAL2/AT: CXTAL2/AT.2 MTSYS(F)/AT.4 XTAL/AT.2(3)
$1N2038: DVBUS.2(A) FUSE+5V.2
$1N9461: CS/LM.2 SPLY+7V.5(SS)
$1N9492: L/LM.2 SPLY+7V.1(SW)
$1N10592: RF1/LM.3 RF2/LM.1 SPLY+7V.8(FB)
$1N11122: CC1/LM.1 RC/LM.2
$1N11605: CC2/LM.1 RC/LM.1 SPLY+7V.7(COMP)
$1N32088: LED+3.3V.1(A) RLED+3.3V.2
$4N1571: C1/AD.2 UARTtoRS232C.1(C1+)
$4N1575: C1/AD.1 UARTtoRS232C.3(C1-)
$4N1757: C2/AD.2 UARTtoRS232C.4(C2+)
$4N3311: C2/AD.1 UARTtoRS232C.5(C2-)
$4N3319: C4/AD.2 UARTtoRS232C.6(V-)
$4N3330: C3/AD.2 UARTtoRS232C.2(V+)
$7N5508: Micro-B.2(D-) RD-/UD.2 Type-C.A7(DN1) Type-C.B7(DN2)
$7N5524: Micro-B.3(D+) RD+/UD.2 Type-C.A6(DP1) Type-C.B6(DP2)
$7N5672: RCC1/UD1.2 Type-C.A5(CC1)
$7N5725: RCC2/UD1.2 Type-C.B5(CC2)
$7N8485: LEDRX/AT.2(+) RLEDRX/AT.2
$7N8666: LEDTX/AT.2(A) RLEDTX/AT.2
$8N2718: RD-/UH.2 Type-A.2(D-)
$8N2723: RD+/UH.2 Type-A.3(D+)
$8N3290: LEDGPO0.2(+) RLEDGPO0.2
$8N3292: LEDGPO1.1(A) RLEDGPO1.2
$8N4284: LEDGPO4.2(A) RLEDGPO4.2
$8N4287: LEDGPO5.2(A) RLEDGPO5.2
$8N4290: LEDGPO6.2(A) RLEDGPO6.2
$8N4293: LEDGPO7.2(+) RLEDGPO7.2
$8N55909: LEDGPO2.2(A) RLEDGPO2.2
$8N63158: LEDGPO3.2(+) RLEDGPO3.2

Not connected (* = marked no-connect by the designer): D-SUB(9F) 1* 4* 6* 9* 10(MH1)* 11(MH2)*; JP+3.3V 1*; JP+5V 1*; JPD+ 1*; JPD- 1*; JPRAW2 3*; JPSS 1*; Micro-B 4(ID)* 6(EH)* 7(EH)* 8(EH)* 9(EH)* 10(EH)* 11(EH)*; MTAPP(F)/AT 5* 15* 16* 19*; MTGPIO(F)/MX 5* 6* 15* 16*; MTSYS(F)/AT 6*; MTSYS(F)/MX 2* 5* 7* 8* 13* 15* 18*; RF1/LM 1*; SPLY+7V 9(N/C)*; Type-A 5* 6* 7* 8*; Type-C 1(SHELL)* 2(SHELL)* 3(SHELL)* 4(SHELL)* A8(SBU1)* B8(SBU2)*

## Notes on the sheets
sheet 1
- power supply
- Red(1.9～2.3V,5mA):
      (3.3-2.1)/0.005=240(Ω)
- Rf1=(Vout/Vfb-1)*Rf2
      =(7.0/1.265-1)*20
      ≒90.7(kΩ)
- power break-out
- ICSP
sheet 2
- UART to RS232C
- RS232C
- re-assigning jumper
sheet 3
- reset
- 10PINs mode selector
- ICSP
- USB+UHS
sheet 4
- mounter for "Sub - ATmega32U4"
- USB(as "DEVICE")
- periferals of "Sub - ATmega32U4"
- PXn break-out
- GreenYellow(2.0V,5mA):
      (3.3-2.0)/0.005=260(Ω)
- Emerald(2.7～3.1V,5mA):
      (3.3-2.9)/0.005=80(Ω)
sheet 5
- mounter for "Sub - MAX3421E"
- USB(as "HOST")
- GPIO
- Amber(1.7～2.2V,5mA):
      (3.3-1.95)/0.005=270(Ω)
- Blue(2.7～3.1V,5mA):
      (3.3-2.9)/0.005=80(Ω)
- Emerald(2.7～3.1V,5mA):
      (3.3-2.9)/0.005=80(Ω)
- GreenYellow(2.0V,5mA):
      (3.3-2.0)/0.005=260(Ω)
- Pink(2.7～3.3V,5mA):
      (3.3-3.0)/0.005=60(Ω)
- Purple(1.9～2.1V,5mA):
      (3.3-2.0)/0.005=260(Ω)
- SkyBlue(2.8V,5mA):
      (3.3-2.8)/0.005=100(Ω)
- periferals of "Sub - MAX3421E"
- White(2.8V,5mA):
      (3.3-2.8)/0.005=100(Ω)
